# EasyEDA Pro project ProProject_IMUSensorNodes202312.epro, board 6_6_拼板20240123（不带编号） (continued)
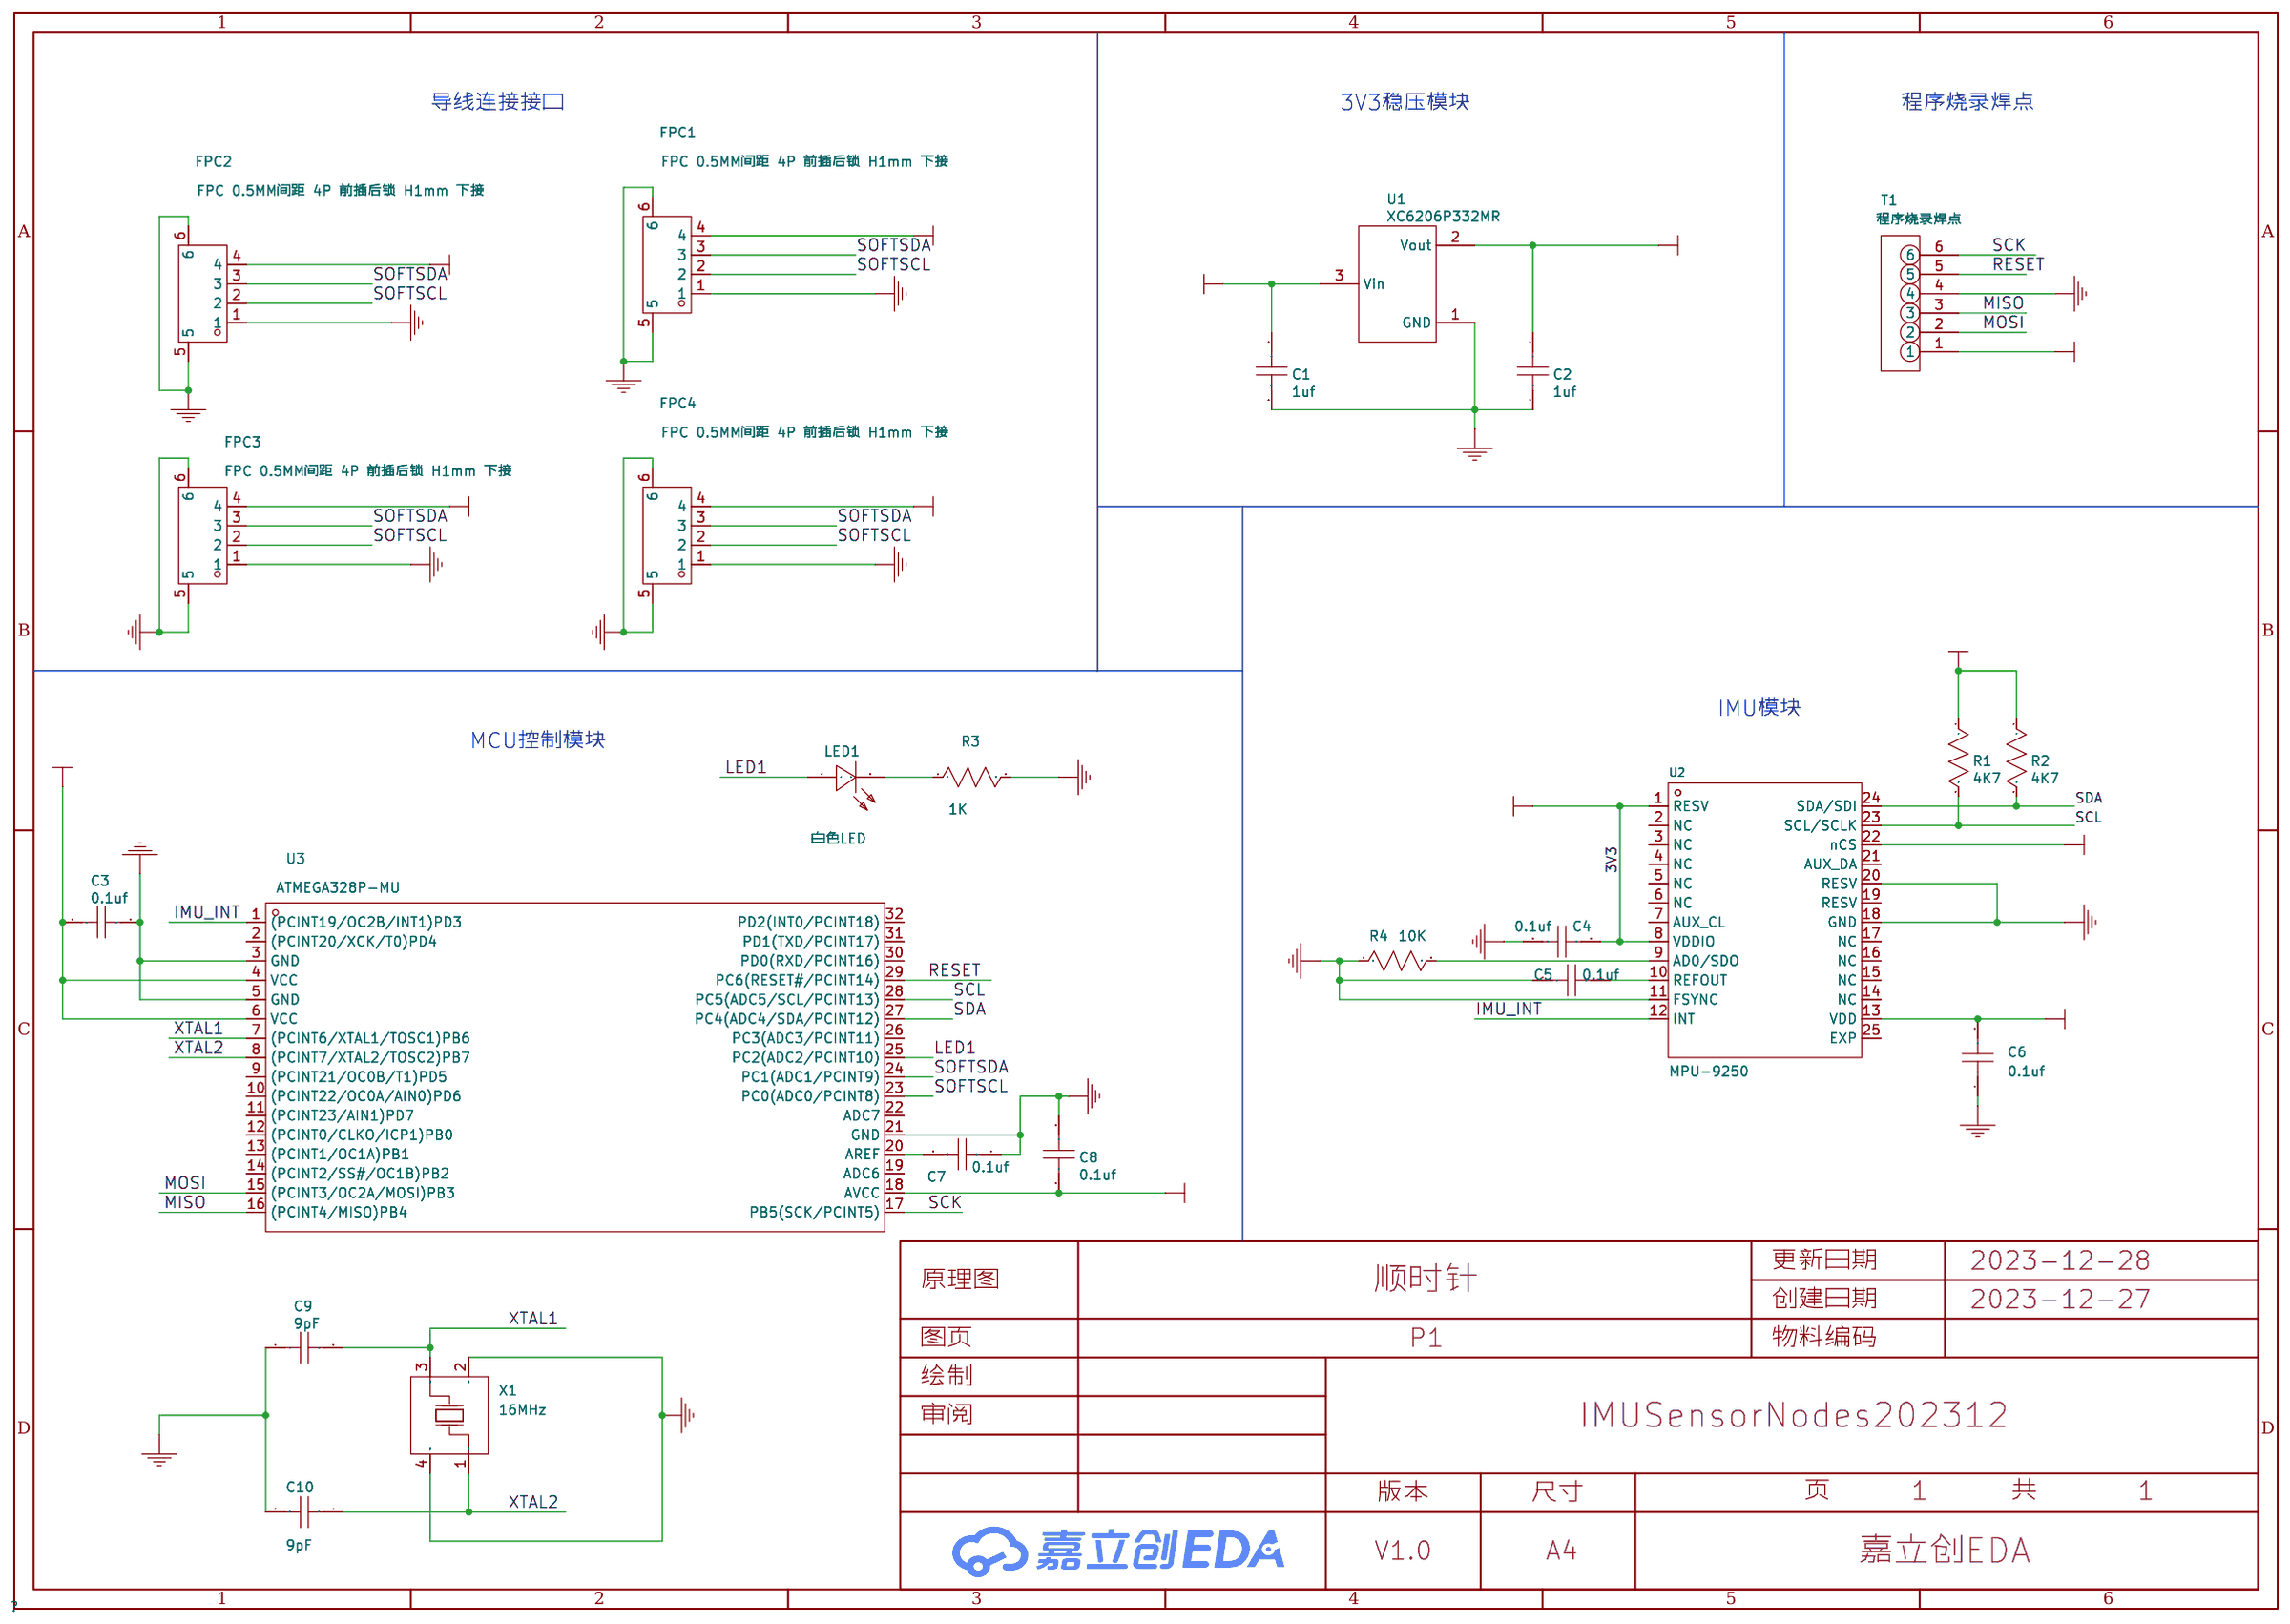
[diagram p0: schematic sheet]
## Routing (per net, layer and track width the routed paths; a pad name or vN(x,y) marks a point on that pad's centre or on a via; arc(x,y) is an arc through that point) (continued)
5V: length 82.8
  Bottom Layer w0.3: v1(22,34.32) 21.77,34.09 C1.1 22.13,33.68 ; 49.94,75.42 49.94,75.73 49.57,76.1 ; 49.57,62.39 49.94,62.01 49.94,61.7 ; U1#35.3 77.25,48.3 77.25,47.99 ; 49.43,47.4 C1#33.1 49.08,47.81 v1(49.31,48.03) ; 49.43,47.4 49.69,47.4 ; 49.43,47.4 arc(49.79,47.25) 49.94,46.89 49.94,46.02 arc(50.08,45.68) v1(50.42,45.54) ; 22.13,33.68 22.38,33.68 ; 22.13,33.68 arc(22.49,33.54) 22.64,33.18 22.64,32.31 arc(22.78,31.97) v1(23.12,31.83) ; 49.57,7.52 49.94,7.15 49.94,6.84 ; 49.57,21.24 49.94,20.86 49.94,20.55 ; v1(22,61.75) 21.77,61.52 C1#25.1 22.13,61.12 ; 22.13,61.12 22.38,61.12 ; 22.13,61.12 arc(22.49,60.97) 22.64,60.61 22.64,59.74 arc(22.78,59.4) v1(23.12,59.26) ; 49.43,33.68 C1#3.1 49.08,34.09 v1(49.31,34.32) ; 49.43,33.68 49.69,33.68 ; 49.43,33.68 arc(49.79,33.54) 49.94,33.18 49.94,32.31 arc(50.08,31.97) v1(50.42,31.83) ; 76.74,47.4 76.99,47.4 ; 76.74,47.4 C1#35.1 76.38,47.81 v1(76.61,48.03) ; 76.74,47.4 arc(77.1,47.25) 77.25,46.89 77.25,46.02 arc(77.39,45.68) v1(77.73,45.54) ; 77.25,6.84 77.25,7.15 U1#18.3 ; v1(76.61,75.47) 76.38,75.24 C1#6.1 76.74,74.83 ; v1(76.61,6.89) 76.38,6.66 C1#18.1 76.74,6.25 ; v1(22,20.6) 21.77,20.37 C1#8.1 22.13,19.97 ; v1(49.31,6.89) 49.08,6.66 C1#16.1 49.43,6.25 ; 22.64,34.27 22.64,34.58 U1.3 ; 22.13,74.83 22.38,74.83 ; 22.13,74.83 C1#21.1 21.77,75.24 v1(22,75.47) ; 22.13,74.83 arc(22.49,74.68) 22.64,74.32 22.64,73.46 arc(22.78,73.12) v1(23.12,72.98) ; 22.13,47.4 C1#31.1 21.77,47.81 v1(22,48.03) ; 22.13,47.4 22.38,47.4 ; 22.13,47.4 arc(22.49,47.25) 22.64,46.89 22.64,46.02 arc(22.78,45.68) v1(23.12,45.54) ; 22.13,6.25 C1#14.1 21.77,6.66 v1(22,6.89) ; 22.13,6.25 22.38,6.25 ; 22.13,6.25 arc(22.49,6.1) 22.64,5.74 22.64,4.88 arc(22.78,4.54) v1(23.12,4.4) ; 49.43,19.97 49.69,19.97 ; 49.43,19.97 C1#10.1 49.08,20.37 v1(49.31,20.6) ; 49.43,19.97 arc(49.79,19.82) 49.94,19.46 49.94,18.59 arc(50.08,18.25) v1(50.42,18.11) ; 22.64,61.7 22.64,62.01 U1#25.3 ; U1#31.3 22.64,48.3 22.64,47.99 ; 76.74,19.97 76.99,19.97 ; 76.74,19.97 C1#12.1 76.38,20.37 v1(76.61,20.6) ; 76.74,19.97 arc(77.1,19.82) 77.25,19.46 77.25,18.59 arc(77.39,18.25) v1(77.73,18.11) ; 76.74,6.25 76.99,6.25 ; 76.74,6.25 arc(77.1,6.1) 77.25,5.74 77.25,4.88 arc(77.39,4.54) v1(77.73,4.4) ; U1#12.3 77.25,20.86 77.25,20.55 ; U1#29.3 77.25,62.01 77.25,61.7 ; 77.25,34.27 77.25,34.58 U1#5.3 ; v1(49.31,75.47) 49.08,75.24 C1#23.1 49.43,74.83 ; 76.74,33.68 C1#5.1 76.38,34.09 v1(76.61,34.32) ; 76.74,33.68 76.99,33.68 ; 76.74,33.68 arc(77.1,33.54) 77.25,33.18 77.25,32.31 arc(77.39,31.97) v1(77.73,31.83) ; 49.43,74.83 49.69,74.83 ; 49.43,74.83 arc(49.79,74.68) 49.94,74.32 49.94,73.46 arc(50.08,73.12) v1(50.42,72.98) ; v1(49.31,61.75) 49.08,61.52 C1#27.1 49.43,61.12 ; 49.57,34.95 49.94,34.58 49.94,34.27 ; 49.43,61.12 49.69,61.12 ; 49.43,61.12 arc(49.79,60.97) 49.94,60.61 49.94,59.74 arc(50.08,59.4) v1(50.42,59.26) ; 49.57,48.67 49.94,48.3 49.94,47.99 ; 22.64,75.42 22.64,75.73 U1#21.3 ; 76.74,61.12 76.99,61.12 ; 76.74,61.12 C1#29.1 76.38,61.52 v1(76.61,61.75) ; 76.74,61.12 arc(77.1,60.97) 77.25,60.61 77.25,59.74 arc(77.39,59.4) v1(77.73,59.26) ; U1#8.3 22.64,20.86 22.64,20.55 ; U1#6.3 77.25,75.73 77.25,75.42 ; 22.64,6.84 22.64,7.15 U1#14.3 ; 49.43,6.25 49.69,6.25 ; 49.43,6.25 arc(49.79,6.1) 49.94,5.74 49.94,4.88 arc(50.08,4.54) v1(50.42,4.4) ; 22.13,19.97 22.38,19.97 ; 22.13,19.97 arc(22.49,19.82) 22.64,19.46 22.64,18.59 arc(22.78,18.25) v1(23.12,18.11) ; 76.74,74.83 76.99,74.83 ; 76.74,74.83 arc(77.1,74.68) 77.25,74.32 77.25,73.46 arc(77.39,73.12) v1(77.73,72.98)
  vias: v1(7.64,73.81) v1(7.64,60.1) v1(7.64,46.38) v1(7.64,32.67) v1(7.64,18.95) v1(7.64,5.23) v1(34.95,73.81) v1(34.95,60.1) v1(34.95,46.38) v1(34.95,32.67) v1(34.95,18.95) v1(34.95,5.23) v1(62.25,73.81) v1(62.25,60.1) v1(62.25,46.38) v1(62.25,32.67) v1(62.25,18.95) v1(62.25,5.23)
GND: length 1731.1
  Top Layer w0.127: X1#17.4 50.18,9.79 50.98,10.59 X1#17.2 ; X1#34.2 50.98,51.74 50.18,50.94 X1#34.4 ; v1(29.11,63.53) 29.94,63.53 30.38,63.97 30.38,65.69 30.76,66.07 31.39,66.07 FPC2#35.6 ; X1#13.2 50.98,24.3 50.18,23.5 X1#13.4 ; X1#8.4 77.48,37.22 78.28,38.02 X1#8.2 ; v1(62.06,71.91) 62.58,72.42 65.35,72.42 FPC3#25.5 ; FPC2#36.6 31.39,11.21 30.76,11.21 30.38,10.82 30.38,9.11 29.94,8.66 v1(29.11,8.66) ; 9.16,78.22 9.16,78.37 9.56,78.77 9.71,78.77 v2(9.96,79.02) ; 63.77,78.22 63.77,78.37 64.17,78.77 64.32,78.77 v2(64.57,79.02) ; X1#15.2 23.67,10.59 22.87,9.79 X1#15.4 ; v2(37.27,24.16) 37.01,23.91 36.86,23.91 36.46,23.5 X1#12.4 ; X1.4 63.77,23.5 64.17,23.91 64.32,23.91 v2(64.57,24.16) ; FPC2#32.6 58.69,11.21 58.07,11.21 57.69,10.82 57.69,9.11 57.25,8.66 v1(56.42,8.66) ; X1#18.4 63.77,9.79 64.17,10.19 64.32,10.19 v2(64.57,10.44) ; X1#28.2 50.98,65.45 50.18,64.65 X1#28.4 ; FPC3#10.5 10.74,44.99 7.97,44.99 v1(7.45,44.47) ; FPC2#25.6 58.69,52.35 58.07,52.35 57.69,51.97 57.69,50.26 57.25,49.81 v1(56.42,49.81) ; 77.48,78.22 77.48,78.37 78.28,79.17 X1#9.2 ; v1(56.42,63.53) 57.25,63.53 57.69,63.97 57.69,65.69 58.07,66.07 58.69,66.07 FPC2#12.6 ; v1(1.81,36.1) 2.64,36.1 3.08,36.54 3.08,38.26 3.46,38.64 4.08,38.64 FPC2#13.6 ; X1#11.4 22.87,23.5 23.67,24.3 X1#11.2 ; v1(1.81,49.81) 2.64,49.81 3.08,50.26 3.08,51.97 3.46,52.35 4.08,52.35 FPC2#10.6 ; FPC3#5.5 65.35,3.84 62.58,3.84 v1(62.06,3.32) ; v2(64.57,51.59) 64.32,51.34 64.17,51.34 63.77,50.94 X1#35.4 ; v1(34.76,44.47) 35.27,44.99 38.04,44.99 FPC3#26.5 ; X1#29.4 63.77,64.65 64.17,65.05 64.32,65.05 v2(64.57,65.31) ; FPC2#7.6 58.69,38.64 58.07,38.64 57.69,38.26 57.69,36.54 57.25,36.1 v1(56.42,36.1) ; X1#26.4 22.87,64.65 23.67,65.45 X1#26.2 ; FPC3#31.5 65.35,31.27 62.58,31.27 v1(62.06,30.76) ; FPC3#32.5 65.35,44.99 62.58,44.99 v1(62.06,44.47) ; FPC3#17.5 38.04,58.7 35.27,58.7 v1(34.76,58.19) ; 36.46,78.22 36.46,78.37 36.86,78.77 37.01,78.77 v2(37.27,79.02) ; X1#33.4 36.46,50.94 36.86,51.34 37.01,51.34 v2(37.27,51.59) ; v1(7.45,17.04) 7.97,17.56 10.74,17.56 FPC3#12.5 ; X1#30.2 78.28,65.45 77.48,64.65 X1#30.4 ; X1#16.4 36.46,9.79 36.86,10.19 37.01,10.19 v2(37.27,10.44) ; v1(7.45,71.91) 7.97,72.42 10.74,72.42 FPC3#36.5 ; X1#25.4 9.16,64.65 9.56,65.05 9.71,65.05 v2(9.96,65.31) ; v2(37.27,65.31) 37.01,65.05 36.86,65.05 36.46,64.65 X1#27.4 ; X1#6.2 50.98,38.02 50.18,37.22 X1#6.4 ; FPC3#8.5 10.74,58.7 7.97,58.7 v1(7.45,58.19) ; v2(9.96,37.88) 9.71,37.62 9.56,37.62 9.16,37.22 X1#3.4 ; v1(1.81,77.25) 2.64,77.25 3.08,77.69 3.08,79.4 3.46,79.78 4.08,79.78 FPC2#8.6 ; FPC3#27.5 10.74,31.27 7.97,31.27 v1(7.45,30.76) ; FPC2#21.6 31.39,38.64 30.76,38.64 30.38,38.26 30.38,36.54 29.94,36.1 v1(29.11,36.1) ; v1(1.81,63.53) 2.64,63.53 3.08,63.97 3.08,65.69 3.46,66.07 4.08,66.07 FPC2#19.6 ; v2(9.96,24.16) 9.71,23.91 9.56,23.91 9.16,23.5 X1#10.4 ; FPC2#11.6 58.69,79.78 58.07,79.78 57.69,79.4 57.69,77.69 57.25,77.25 v1(56.42,77.25) ; v1(29.11,22.38) 29.94,22.38 30.38,22.82 30.38,24.54 30.76,24.92 31.39,24.92 FPC2#33.6 ; X1#19.4 77.48,9.79 78.28,10.59 X1#19.2 ; FPC3#20.5 38.04,72.42 35.27,72.42 v1(34.76,71.91) ; v2(9.96,51.59) 9.71,51.34 9.56,51.34 9.16,50.94 X1#31.4 ; 50.18,78.22 50.18,78.37 50.98,79.17 X1#24.2 ; v1(62.06,58.19) 62.58,58.7 65.35,58.7 FPC3#30.5 ; FPC3#14.5 38.04,3.84 35.27,3.84 v1(34.76,3.32) ; X1#36.2 78.28,51.74 77.48,50.94 X1#36.4 ; v1(34.76,30.76) 35.27,31.27 38.04,31.27 FPC3.5 ; FPC3#15.5 10.74,3.84 7.97,3.84 v1(7.45,3.32) ; FPC3#13.5 65.35,17.56 62.58,17.56 v1(62.06,17.04) ; v2(64.57,37.88) 64.32,37.62 64.17,37.62 63.77,37.22 X1#7.4 ; FPC2#23.6 31.39,79.78 30.76,79.78 30.38,79.4 30.38,77.69 29.94,77.25 v1(29.11,77.25) ; FPC2#4.6 4.08,11.21 3.46,11.21 3.08,10.82 3.08,9.11 2.64,8.66 v1(1.81,8.66) ; X1#22.2 23.67,79.17 22.87,78.37 22.87,78.22 ; X1#2.4 77.48,23.5 78.28,24.3 X1#2.2 ; v1(1.81,22.38) 2.64,22.38 3.08,22.82 3.08,24.54 3.46,24.92 4.08,24.92 FPC2#6.6 ; FPC2#9.6 31.39,52.35 30.76,52.35 30.38,51.97 30.38,50.26 29.94,49.81 v1(29.11,49.81) ; v2(37.27,37.88) 37.01,37.62 36.86,37.62 36.46,37.22 X1#5.4 ; X1#4.4 22.87,37.22 23.67,38.02 X1#4.2 ; X1#32.4 22.87,50.94 23.67,51.74 X1#32.2 ; v2(9.96,10.44) 9.71,10.19 9.56,10.19 9.16,9.79 X1#14.4 ; FPC2#34.6 58.69,24.92 58.07,24.92 57.69,24.54 57.69,22.82 57.25,22.38 v1(56.42,22.38) ; v1(34.76,17.04) 35.27,17.56 38.04,17.56 FPC3#6.5
  Top Layer w0.2: FPC1#21.4 29.89,18.96 29.24,18.32 ; 29.24,4.6 29.89,5.25 FPC1#2.4 ; 69.65,32.3 70.88,32.3 v1(71.28,31.91) ; 76.36,49.43 78.92,49.43 FPC3#33.6 ; FPC3#28.6 24.31,49.43 21.75,49.43 ; 42.34,32.3 43.58,32.3 v1(43.97,31.91) ; v1(16.67,73.05) 16.27,73.45 15.03,73.45 ; v1(43.97,45.62) 43.58,46.02 42.34,46.02 ; 76.36,63.15 78.92,63.15 FPC3#11.6 ; 1.94,32.04 2.58,32.68 FPC1#12.4 ; FPC1#13.4 2.58,5.25 1.94,4.6 ; v1(16.67,18.19) 16.27,18.58 15.03,18.58 ; 69.65,4.87 70.88,4.87 v1(71.28,4.47) ; FPC3#3.6 78.92,22 76.36,22 ; 56.55,4.6 57.19,5.25 FPC1#28.4 ; 76.36,35.72 78.92,35.72 FPC3#23.6 ; v1(71.28,45.62) 70.88,46.02 69.65,46.02 ; 49.05,8.28 51.62,8.28 FPC3#34.6 ; FPC1#34.4 57.19,18.96 56.55,18.32 ; FPC1#17.4 57.19,46.4 56.55,45.75 ; v1(71.28,59.34) 70.88,59.73 69.65,59.73 ; FPC1#36.4 29.89,32.68 29.24,32.04 ; 21.75,8.28 24.31,8.28 FPC3#29.6 ; 15.03,59.73 16.27,59.73 v1(16.67,59.34) ; 49.05,22 51.62,22 FPC3#18.6 ; 49.05,63.15 51.62,63.15 FPC3#24.6 ; 76.36,8.28 78.92,8.28 FPC3#35.6 ; FPC1#18.4 29.89,46.4 29.24,45.75 ; FPC1#32.4 2.58,46.4 1.94,45.75 ; v1(43.97,18.19) 43.58,18.58 42.34,18.58 ; 69.65,73.45 70.88,73.45 v1(71.28,73.05) ; 29.24,59.47 29.89,60.11 FPC1#14.4 ; 49.05,35.72 51.62,35.72 FPC3#9.6 ; v1(43.97,73.05) 43.58,73.45 42.34,73.45 ; FPC1#8.4 57.19,73.83 56.55,73.18 ; v1(71.28,18.19) 70.88,18.58 69.65,18.58 ; 56.55,32.04 57.19,32.68 FPC1#24.4 ; 21.75,35.72 24.31,35.72 FPC3#7.6 ; v1(43.97,59.34) 43.58,59.73 42.34,59.73 ; v1(16.67,31.91) 16.27,32.3 15.03,32.3 ; FPC3#4.6 78.92,76.86 76.36,76.86 ; 21.75,76.86 24.31,76.86 FPC3#16.6 ; 1.94,73.18 2.58,73.83 FPC1#4.4 ; 42.34,4.87 43.58,4.87 v1(43.97,4.47) ; 21.75,63.15 24.31,63.15 FPC3#19.6 ; 21.75,22 24.31,22 FPC3#2.6 ; FPC1#31.4 29.89,73.83 29.24,73.18 ; FPC1#6.4 57.19,60.11 56.55,59.47 ; 49.05,76.86 51.62,76.86 FPC3#21.6 ; 15.03,46.02 16.27,46.02 v1(16.67,45.62) ; 15.03,4.87 16.27,4.87 v1(16.67,4.47) ; FPC1#5.4 2.58,18.96 1.94,18.32 ; FPC3#22.6 51.62,49.43 49.05,49.43 ; 1.94,59.47 2.58,60.11 FPC1.4
  Top Layer w0.22: FPC1#12.6 1.54,31.64 1.94,32.04 ; 56.55,45.75 56.15,45.35 FPC1#17.6 ; FPC1#18.6 28.84,45.35 29.24,45.75 ; FPC1#36.6 28.84,31.64 29.24,32.04 ; 1.94,73.18 1.54,72.78 FPC1#4.6 ; 29.24,4.6 28.84,4.2 FPC1#2.6 ; 56.55,59.47 56.15,59.07 FPC1#6.6 ; 1.94,18.32 1.54,17.92 FPC1#5.6 ; 29.24,73.18 28.84,72.78 FPC1#31.6 ; 1.94,4.6 1.54,4.2 FPC1#13.6 ; 56.55,32.04 56.15,31.64 FPC1#24.6 ; FPC1#8.6 56.15,72.78 56.55,73.18 ; 56.55,18.32 56.15,17.92 FPC1#34.6 ; FPC1.6 1.54,59.07 1.94,59.47 ; 1.94,45.75 1.54,45.35 FPC1#32.6 ; FPC1#28.6 56.15,4.2 56.55,4.6 ; FPC1#14.6 28.84,59.07 29.24,59.47 ; FPC1#21.6 28.84,17.92 29.24,18.32
  Top Layer w0.254: 69.24,4.46 FPC1#7.5 69.43,8 v1(69.9,8) ; 69.24,4.46 70.66,5.89 70.66,6.4 71.01,6.75 FPC1#7.1 ; 69.24,4.46 FPC1#7.6 ; 37.84,38.17 X1#5.2 37.24,38.19 37.24,38.76 ; 37.84,38.17 37.24,38.76 ; 37.84,38.17 38.02,38.17 v1(38.51,37.68) ; 37.24,25.05 37.84,24.45 ; 37.24,25.05 37.12,25.17 35.49,25.17 FPC2#33.5 ; 37.24,25.05 37.24,24.47 X1#12.2 37.84,24.45 ; 37.84,24.45 38.02,24.45 v1(38.51,23.96) ; v1(69.9,49.15) 69.43,49.15 FPC1#29.5 69.24,45.61 ; v1(44.9,51.34) 45.23,51.67 FPC2#24.6 45.6,52.61 48.46,52.61 FPC2#24.5 48.83,50.87 48.92,50.79 ; FPC2#35.5 35.49,66.32 37.12,66.32 37.24,66.2 ; 37.84,51.89 X1#33.2 37.24,51.91 37.24,52.48 ; 37.84,51.89 38.02,51.89 v1(38.51,51.4) ; 37.84,51.89 37.24,52.48 ; FPC1#29.6 69.24,45.61 ; 69.24,45.61 70.66,47.03 70.66,47.55 71.01,47.9 FPC1#29.1 ; FPC1#35.6 14.63,73.04 ; 14.63,73.04 FPC1#35.5 14.82,76.58 v1(15.29,76.58) ; 14.63,73.04 16.05,74.47 16.05,74.98 16.4,75.33 FPC1#35.1 ; FPC1#30.1 71.01,61.61 70.66,61.26 70.66,60.75 69.24,59.33 ; 41.94,18.18 43.36,19.6 43.36,20.12 43.71,20.46 FPC1#9.1 ; 41.94,18.18 FPC1#9.5 42.12,21.71 v1(42.6,21.71) ; 41.94,18.18 FPC1#9.6 ; FPC1#19.6 14.63,18.18 ; 14.63,18.18 16.05,19.6 16.05,20.12 16.4,20.46 FPC1#19.1 ; 14.63,18.18 FPC1#19.5 14.82,21.71 v1(15.29,21.71) ; X1#6.4 48.92,37.07 ; 48.92,37.07 48.92,36.94 v1(48.04,36.06) 48.38,35.72 49.05,35.72 ; 48.92,37.07 48.83,37.16 FPC2#27.5 48.46,38.89 45.6,38.89 FPC2#27.6 45.23,37.96 v1(44.9,37.63) ; 64.55,38.76 64.42,38.89 62.79,38.89 FPC2#7.5 ; 64.55,38.76 64.55,38.19 X1#7.2 65.14,38.17 ; 64.55,38.76 65.14,38.17 ; v1(1.81,22.38) 1.77,22.38 FPC1#5.5 ; 21.61,23.36 21.53,23.44 FPC2#5.5 21.15,25.17 18.3,25.17 FPC2#5.6 17.92,24.24 v1(17.59,23.91) ; 21.61,23.36 21.61,23.23 v1(20.73,22.35) 21.08,22 21.75,22 ; 21.61,23.36 X1#11.4 ; 64.55,25.05 64.42,25.17 62.79,25.17 FPC2#34.5 ; 64.55,25.05 64.55,24.47 X1.2 65.14,24.45 ; 64.55,25.05 65.14,24.45 ; 64.55,11.33 64.42,11.46 62.79,11.46 FPC2#32.5 ; 64.55,11.33 64.55,10.76 X1#18.2 65.14,10.74 ; 64.55,11.33 65.14,10.74 ; 49.05,49.43 48.38,49.43 v1(48.04,49.78) 48.92,50.66 48.92,50.79 ; 14.63,45.61 FPC1#27.5 14.82,49.15 v1(15.29,49.15) ; 14.63,45.61 FPC1#27.6 ; 14.63,45.61 16.05,47.03 16.05,47.55 16.4,47.9 FPC1#27.1 ; v1(11.21,23.96) 10.72,24.45 10.53,24.45 ; 69.24,73.04 FPC1#15.5 69.43,76.58 v1(69.9,76.58) ; 69.24,73.04 FPC1#15.6 ; 69.24,73.04 70.66,74.47 70.66,74.98 71.01,75.33 FPC1#15.1 ; R3#3.2 41.81,29.02 arc(41.94,28.73) v1(42.23,28.6) ; 65.14,51.89 65.33,51.89 v1(65.82,51.4) ; 65.14,51.89 64.55,52.48 ; 65.14,51.89 X1#35.2 64.55,51.91 64.55,52.48 ; 37.84,79.32 38.02,79.32 v1(38.51,78.83) ; 37.84,79.32 X1#23.2 37.24,79.34 37.24,79.91 ; 37.84,79.32 37.24,79.91 ; v1(17.59,78.78) 17.92,79.1 FPC2#30.6 18.3,80.04 21.15,80.04 FPC2#30.5 21.53,78.31 21.61,78.22 ; X1#30.4 76.22,64.5 ; 76.22,64.5 76.22,64.38 v1(75.34,63.5) 75.69,63.15 76.36,63.15 ; 76.22,64.5 76.14,64.59 FPC2#31.5 75.76,66.32 72.91,66.32 FPC2#31.6 72.53,65.39 v1(72.2,65.06) ; 9.94,38.76 9.94,38.19 X1#3.2 10.53,38.17 ; 9.94,38.76 10.53,38.17 ; 9.94,38.76 9.81,38.89 8.19,38.89 FPC2#13.5 ; 76.22,23.36 76.22,23.23 v1(75.34,22.35) 75.69,22 76.36,22 ; 76.22,23.36 X1#2.4 ; 76.22,23.36 76.14,23.44 FPC2#20.5 75.76,25.17 72.91,25.17 FPC2#20.6 72.53,24.24 v1(72.2,23.91) ; v1(65.82,10.25) 65.33,10.74 65.14,10.74 ; 76.36,35.72 75.69,35.72 v1(75.34,36.06) 76.22,36.94 76.22,37.07 ; 10.53,10.74 X1#14.2 9.94,10.76 9.94,11.33 ; 10.53,10.74 9.94,11.33 ; 10.53,10.74 10.72,10.74 v1(11.21,10.25) ; R3#23.2 41.81,70.17 arc(41.94,69.87) v1(42.23,69.75) ; FPC1#16.6 41.94,45.61 ; 41.94,45.61 43.36,47.03 43.36,47.55 43.71,47.9 FPC1#16.1 ; 41.94,45.61 FPC1#16.5 42.12,49.15 v1(42.6,49.15) ; 48.92,23.36 48.92,23.23 v1(48.04,22.35) 48.38,22 49.05,22 ; 48.92,23.36 X1#13.4 ; 48.92,23.36 48.83,23.44 FPC2#16.5 48.46,25.17 45.6,25.17 FPC2#16.6 45.23,24.24 v1(44.9,23.91) ; 76.22,37.07 76.14,37.16 FPC2#18.5 75.76,38.89 72.91,38.89 FPC2#18.6 72.53,37.96 v1(72.2,37.63) ; 76.22,37.07 X1#8.4 ; v1(11.21,37.68) 10.72,38.17 10.53,38.17 ; R3#35.2 69.12,42.74 arc(69.24,42.44) v1(69.54,42.32) ; 65.14,65.6 65.33,65.6 v1(65.82,65.11) ; 65.14,65.6 64.55,66.2 ; 65.14,65.6 X1#29.2 64.55,65.62 64.55,66.2 ; FPC2#19.5 8.19,66.32 9.81,66.32 9.94,66.2 ; 49.05,63.15 48.38,63.15 v1(48.04,63.5) 48.92,64.38 48.92,64.5 ; 37.24,79.91 37.12,80.04 35.49,80.04 FPC2#23.5 ; v1(29.11,36.1) 29.08,36.1 FPC1#36.5 ; v1(1.81,36.1) 1.77,36.1 FPC1#12.5 ; 64.55,66.2 64.42,66.32 62.79,66.32 FPC2#12.5 ; FPC1.5 1.77,63.53 v1(1.81,63.53) ; 14.63,59.33 16.05,60.75 16.05,61.26 16.4,61.61 FPC1#23.1 ; 14.63,59.33 FPC1#23.5 14.82,62.86 v1(15.29,62.86) ; 14.63,59.33 FPC1#23.6 ; 48.92,64.5 48.83,64.59 FPC2#26.5 48.46,66.32 45.6,66.32 FPC2#26.6 45.23,65.39 v1(44.9,65.06) ; 48.92,64.5 X1#28.4 ; 65.14,24.45 65.33,24.45 v1(65.82,23.96) ; v1(72.2,51.34) 72.53,51.67 FPC2.6 72.91,52.61 75.76,52.61 FPC2.5 76.14,50.87 76.22,50.79 ; 37.24,52.48 37.12,52.61 35.49,52.61 FPC2#9.5 ; 64.55,52.48 64.42,52.61 62.79,52.61 FPC2#25.5 ; 9.94,52.48 9.81,52.61 8.19,52.61 FPC2#10.5 ; 9.94,52.48 9.94,51.91 X1#31.2 10.53,51.89 ; 9.94,52.48 10.53,51.89 ; 9.94,11.33 9.81,11.46 8.19,11.46 FPC2#4.5 ; 48.92,9.64 48.92,9.51 v1(48.04,8.63) 48.38,8.28 49.05,8.28 ; 48.92,9.64 X1#17.4 ; 48.92,9.64 48.83,9.73 FPC2#22.5 48.46,11.46 45.6,11.46 FPC2#22.6 45.23,10.52 v1(44.9,10.19) ; R3#14.2 14.51,1.59 arc(14.63,1.29) v1(14.93,1.17) ; FPC1#32.5 1.77,49.81 v1(1.81,49.81) ; v1(44.9,78.78) 45.23,79.1 FPC2#2.6 45.6,80.04 48.46,80.04 FPC2#2.5 48.83,78.31 48.92,78.22 ; FPC1#28.5 56.38,8.66 v1(56.42,8.66) ; v1(17.59,51.34) 17.92,51.67 FPC2#29.6 18.3,52.61 21.15,52.61 FPC2#29.5 21.53,50.87 21.61,50.79 ; 48.92,50.79 X1#34.4 ; v1(1.81,8.66) 1.77,8.66 FPC1#13.5 ; FPC1#17.5 56.38,49.81 v1(56.42,49.81) ; v1(15.29,35.43) 14.82,35.43 FPC1#33.5 14.63,31.89 ; 21.75,49.43 21.08,49.43 v1(20.73,49.78) 21.61,50.66 21.61,50.79 ; FPC1#25.6 69.24,18.18 ; 69.24,18.18 FPC1#25.5 69.43,21.71 v1(69.9,21.71) ; 69.24,18.18 70.66,19.6 70.66,20.12 71.01,20.46 FPC1#25.1 ; 37.24,66.2 37.84,65.6 ; 37.24,66.2 37.24,65.62 X1#27.2 37.84,65.6 ; 37.84,65.6 38.02,65.6 v1(38.51,65.11) ; R3#6.2 69.12,70.17 arc(69.24,69.87) v1(69.54,69.75) ; 10.53,79.32 X1#20.2 9.94,79.34 9.94,79.91 ; 10.53,79.32 10.72,79.32 v1(11.21,78.83) ; 10.53,79.32 9.94,79.91 ; FPC1#10.1 16.4,6.75 16.05,6.4 16.05,5.89 14.63,4.46 ; 37.24,38.76 37.12,38.89 35.49,38.89 FPC2#21.5 ; 21.61,37.07 21.53,37.16 FPC2#17.5 21.15,38.89 18.3,38.89 FPC2#17.6 17.92,37.96 v1(17.59,37.63) ; 21.61,37.07 21.61,36.94 v1(20.73,36.06) 21.08,35.72 21.75,35.72 ; 21.61,37.07 X1#4.4 ; v1(1.81,77.25) 1.77,77.25 FPC1#4.5 ; v1(56.42,77.25) 56.38,77.25 FPC1#8.5 ; FPC2#8.5 8.19,80.04 9.81,80.04 9.94,79.91 ; 41.94,4.46 FPC1#22.5 42.12,8 v1(42.6,8) ; 41.94,4.46 FPC1#22.6 ; 41.94,4.46 43.36,5.89 43.36,6.4 43.71,6.75 FPC1#22.1 ; R3#27.2 41.81,56.45 arc(41.94,56.16) v1(42.23,56.04) ; X1#15.4 21.61,9.64 ; 21.61,9.64 21.53,9.73 FPC2#14.5 21.15,11.46 18.3,11.46 FPC2#14.6 17.92,10.52 v1(17.59,10.19) ; 21.61,9.64 21.61,9.51 v1(20.73,8.63) 21.08,8.28 21.75,8.28 ; v1(29.11,8.66) 29.08,8.66 FPC1#2.5 ; 76.36,76.86 75.69,76.86 v1(75.34,77.21) 76.22,78.09 76.22,78.22 ; 48.92,78.22 48.92,78.09 v1(48.04,77.21) 48.38,76.86 49.05,76.86 ; 48.92,78.22 50.18,78.22 ; v1(72.2,10.19) 72.53,10.52 FPC2#15.6 72.91,11.46 75.76,11.46 FPC2#15.5 76.14,9.73 76.22,9.64 ; 37.24,11.33 37.84,10.74 ; 37.24,11.33 37.12,11.46 35.49,11.46 FPC2#36.5 ; 37.24,11.33 37.24,10.76 X1#16.2 37.84,10.74 ; 37.84,10.74 38.02,10.74 v1(38.51,10.25) ; 21.61,50.79 X1#32.4 ; 76.36,49.43 75.69,49.43 v1(75.34,49.78) 76.22,50.66 76.22,50.79 ; v1(56.42,36.1) 56.38,36.1 FPC1#24.5 ; FPC1#26.6 41.94,31.89 ; 41.94,31.89 43.36,33.32 43.36,33.83 43.71,34.18 FPC1#26.1 ; 41.94,31.89 FPC1#26.5 42.12,35.43 v1(42.6,35.43) ; 9.94,66.2 9.94,65.62 X1#25.2 10.53,65.6 ; 9.94,66.2 10.53,65.6 ; FPC1#33.6 14.63,31.89 ; 14.63,31.89 16.05,33.32 16.05,33.83 16.4,34.18 FPC1#33.1 ; FPC1#3.6 69.24,31.89 ; 69.24,31.89 FPC1#3.5 69.43,35.43 v1(69.9,35.43) ; 69.24,31.89 70.66,33.32 70.66,33.83 71.01,34.18 FPC1#3.1 ; FPC1#21.5 29.08,22.38 v1(29.11,22.38) ; 65.14,79.32 65.33,79.32 v1(65.82,78.83) ; 65.14,79.32 X1#21.2 64.55,79.34 64.55,79.91 ; 65.14,79.32 64.55,79.91 ; 69.24,59.33 FPC1#30.6 ; 69.24,59.33 FPC1#30.5 69.43,62.86 v1(69.9,62.86) ; v1(11.21,51.4) 10.72,51.89 10.53,51.89 ; v1(29.11,49.81) 29.08,49.81 FPC1#18.5 ; FPC1#14.5 29.08,63.53 v1(29.11,63.53) ; v1(42.6,76.58) 42.12,76.58 FPC1#20.5 41.94,73.04 ; v1(15.29,8) 14.82,8 FPC1#10.5 14.63,4.46 ; v1(11.21,65.11) 10.72,65.6 10.53,65.6 ; 76.22,50.79 X1#36.4 ; v1(72.2,78.78) 72.53,79.1 FPC2#3.6 72.91,80.04 75.76,80.04 FPC2#3.5 76.14,78.31 76.22,78.22 ; 76.22,9.64 76.22,9.51 v1(75.34,8.63) 75.69,8.28 76.36,8.28 ; 76.22,9.64 X1#19.4 ; v1(42.6,62.86) 42.12,62.86 FPC1#11.5 41.94,59.33 ; FPC1#31.5 29.08,77.25 v1(29.11,77.25) ; R3#33.2 41.81,42.74 arc(41.94,42.44) v1(42.23,42.32) ; 22.87,78.22 21.61,78.22 ; 21.61,78.22 21.61,78.09 v1(20.73,77.21) 21.08,76.86 21.75,76.86 ; FPC2#11.5 62.79,80.04 64.42,80.04 64.55,79.91 ; v1(56.42,63.53) 56.38,63.53 FPC1#6.5 ; FPC1#11.1 43.71,61.61 43.36,61.26 43.36,60.75 41.94,59.33 ; 9.94,25.05 9.81,25.17 8.19,25.17 FPC2#6.5 ; 9.94,25.05 10.53,24.45 ; 9.94,25.05 9.94,24.47 X1#10.2 10.53,24.45 ; R3#10.2 41.81,15.31 arc(41.94,15.01) v1(42.23,14.89) ; 76.22,78.22 77.48,78.22 ; R3#21.2 14.51,70.17 arc(14.63,69.87) v1(14.93,69.75) ; R3#31.2 14.51,42.74 arc(14.63,42.44) v1(14.93,42.32) ; X1#26.4 21.61,64.5 ; 21.61,64.5 21.53,64.59 FPC2#28.5 21.15,66.32 18.3,66.32 FPC2#28.6 17.92,65.39 v1(17.59,65.06) ; 21.61,64.5 21.61,64.38 v1(20.73,63.5) 21.08,63.15 21.75,63.15 ; FPC1#20.6 41.94,73.04 ; 41.94,73.04 43.36,74.47 43.36,74.98 43.71,75.33 FPC1#20.1 ; R3#25.2 14.51,56.45 arc(14.63,56.16) v1(14.93,56.04) ; 41.94,59.33 FPC1#11.6 ; FPC1#10.6 14.63,4.46 ; R3#18.2 69.12,1.59 arc(69.24,1.29) v1(69.54,1.17) ; R3#16.2 41.81,1.59 arc(41.94,1.29) v1(42.23,1.17) ; R3#8.2 14.51,15.31 arc(14.63,15.01) v1(14.93,14.89) ; R3.2 14.51,29.02 arc(14.63,28.73) v1(14.93,28.6) ; R3#29.2 69.12,56.45 arc(69.24,56.16) v1(69.54,56.04) ; 65.14,38.17 65.33,38.17 v1(65.82,37.68) ; v1(56.42,22.38) 56.38,22.38 FPC1#34.5 ; R3#5.2 69.12,29.02 arc(69.24,28.73) v1(69.54,28.6) ; R3#12.2 69.12,15.31 arc(69.24,15.01) v1(69.54,14.89)
  Top Layer w0.4: FPC3#33.5 FPC3#33.6 79.41,51.47 v1(79.53,51.59) ; FPC3#3.5 FPC3#3.6 79.41,24.04 v1(79.53,24.16) ; FPC1#21.5 FPC1#21.6 ; FPC1#28.5 FPC1#28.6 ; v1(24.92,79.02) 24.8,78.9 FPC3#16.6 FPC3#16.5 ; FPC3#34.5 FPC3#34.6 52.11,10.32 v1(52.23,10.44) ; FPC3#29.5 FPC3#29.6 24.8,10.32 v1(24.92,10.44) ; FPC3#4.5 FPC3#4.6 79.41,78.9 v1(79.53,79.02) ; FPC3#28.5 FPC3#28.6 24.8,51.47 v1(24.92,51.59) ; v1(24.92,24.16) 24.8,24.04 FPC3#2.6 FPC3#2.5 ; FPC3#19.5 FPC3#19.6 24.8,65.19 v1(24.92,65.31) ; v1(24.92,37.88) 24.8,37.75 FPC3#7.6 FPC3#7.5 ; FPC3#23.5 FPC3#23.6 79.41,37.75 v1(79.53,37.88) ; v1(52.23,51.59) 52.11,51.47 FPC3#22.6 FPC3#22.5 ; FPC1#13.5 FPC1#13.6 ; FPC3#24.5 FPC3#24.6 52.11,65.19 v1(52.23,65.31) ; FPC1#14.5 FPC1#14.6 ; v1(79.53,65.31) 79.41,65.19 FPC3#11.6 FPC3#11.5 ; FPC1#2.5 FPC1#2.6 ; FPC3#21.5 FPC3#21.6 52.11,78.9 v1(52.23,79.02) ; FPC1#34.5 FPC1#34.6 ; FPC1#6.5 FPC1#6.6 ; FPC3#9.5 FPC3#9.6 52.11,37.75 v1(52.23,37.88) ; FPC1.5 FPC1.6 ; FPC1#32.5 FPC1#32.6 ; FPC1#24.5 FPC1#24.6 ; FPC1#12.5 FPC1#12.6 ; FPC1#4.5 FPC1#4.6 ; FPC3#35.5 FPC3#35.6 79.41,10.32 v1(79.53,10.44) ; FPC1#5.5 FPC1#5.6 ; FPC1#36.5 FPC1#36.6 ; FPC3#18.5 FPC3#18.6 52.11,24.04 v1(52.23,24.16) ; FPC1#17.5 FPC1#17.6 ; FPC1#31.5 FPC1#31.6 ; FPC1#18.5 FPC1#18.6 ; FPC1#8.5 FPC1#8.6
  Bottom Layer w0.127: 23.55,38.13 23.55,36.86 C10#4.2 ; C4#33.2 35.59,52.1 35.81,52.31 36.48,52.31 36.76,52.04 C9#33.1 ; C4#12.2 62.9,79.53 63.11,79.75 63.78,79.75 64.06,79.47 C9#21.1 ; 78,51.84 77.88,51.97 77.88,52.1 ; C10#6.2 50.85,36.86 50.85,38.13 ; C4#27.2 35.59,65.81 35.81,66.03 36.48,66.03 36.76,65.75 C9#27.1 ; 23.39,10.7 23.27,10.82 23.27,10.95 ; C10#9.2 78.16,78.01 78.16,79.28 ; C4#29.2 62.9,65.81 63.11,66.03 63.78,66.03 64.06,65.75 C9#29.1 ; C10#34.2 50.85,50.58 50.85,51.84 ; C9#20.1 9.45,79.47 9.17,79.75 8.5,79.75 8.29,79.53 C4#21.2 ; 23.27,79.53 23.27,79.4 23.39,79.28 ; 23.27,38.38 23.27,38.25 23.39,38.13 ; 50.58,52.1 50.58,51.97 50.7,51.84 ; C4#35.2 62.9,52.1 63.11,52.31 63.78,52.31 64.06,52.04 C9#35.1 ; C4#14.2 62.9,24.67 63.11,24.88 63.78,24.88 64.06,24.61 C9.1 ; 23.55,79.28 23.55,78.01 C10#22.2 ; 50.58,10.95 50.58,10.82 50.7,10.7 ; 78,24.41 77.88,24.53 77.88,24.67 ; 50.7,79.28 50.58,79.4 50.58,79.53 ; C9#16.1 36.76,10.89 36.48,11.17 35.81,11.17 35.59,10.95 C4#17.2 ; 23.39,24.41 23.27,24.53 23.27,24.67 ; 50.58,65.81 50.58,65.68 50.7,65.56 ; C4#9.2 8.29,24.67 8.5,24.88 9.17,24.88 9.45,24.61 C9#10.1 ; C4#23.2 35.59,79.53 35.81,79.75 36.48,79.75 36.76,79.47 C9#23.1 ; 77.88,79.53 77.88,79.4 78,79.28 ; 50.58,38.38 50.58,38.25 50.7,38.13 ; C10#11.2 23.55,23.14 23.55,24.41 ; 78,65.56 77.88,65.68 77.88,65.81 ; C4#15.2 8.29,10.95 8.5,11.17 9.17,11.17 9.45,10.89 C9#14.1 ; 23.39,65.56 23.27,65.68 23.27,65.81 ; C9#31.1 9.45,52.04 9.17,52.31 8.5,52.31 8.29,52.1 C4#31.2 ; C10#17.2 50.85,9.43 50.85,10.7 ; 78,38.13 77.88,38.25 77.88,38.38 ; C10#32.2 23.55,50.58 23.55,51.84 ; C10#19.2 78.16,9.43 78.16,10.7 ; C4#19.2 62.9,10.95 63.11,11.17 63.78,11.17 64.06,10.89 C9#18.1 ; C9#7.1 64.06,38.32 63.78,38.6 63.11,38.6 62.9,38.38 C4#6.2 ; C9#12.1 36.76,24.61 36.48,24.88 35.81,24.88 35.59,24.67 C4#11.2 ; C10#36.2 78.16,50.58 78.16,51.84 ; 50.85,24.41 50.85,23.14 C10#13.2 ; 50.58,24.67 50.58,24.53 50.7,24.41 ; 78,10.7 77.88,10.82 77.88,10.95 ; 23.55,65.56 23.55,64.29 C10#26.2 ; C4#25.2 8.29,65.81 8.5,66.03 9.17,66.03 9.45,65.75 C9#25.1 ; C10#15.2 23.55,9.43 23.55,10.7 ; C10#30.2 78.16,64.29 78.16,65.56 ; 78.16,38.13 78.16,36.86 C10#8.2 ; 23.39,51.84 23.27,51.97 23.27,52.1 ; C9#3.1 9.45,38.32 9.17,38.6 8.5,38.6 8.29,38.38 C4#2.2 ; C10#24.2 50.85,78.01 50.85,79.28 ; C10#2.2 78.16,23.14 78.16,24.41 ; C10#28.2 50.85,64.29 50.85,65.56 ; C4#4.2 35.59,38.38 35.81,38.6 36.48,38.6 36.76,38.32 C9#5.1
  Bottom Layer w0.15: v1(23.67,65.28) 23.67,65.42 23.15,65.94 22.15,65.94 C4#26.2 ; C4#8.2 76.76,79.66 77.75,79.66 78.28,79.13 v1(78.28,79) ; v1(78.28,51.57) 78.28,51.7 77.75,52.23 76.76,52.23 C4#36.2 ; C4#13.2 49.46,24.79 50.45,24.79 50.98,24.27 v1(50.98,24.13) ; v1(78.28,65.28) 78.28,65.42 77.75,65.94 76.76,65.94 C4#30.2 ; v1(50.98,10.42) 50.98,10.55 50.45,11.08 49.46,11.08 C4#18.2 ; v1(50.98,51.57) 50.98,51.7 50.45,52.23 49.46,52.23 C4#34.2 ; C4.2 76.76,24.79 77.75,24.79 78.28,24.27 v1(78.28,24.13) ; C4#28.2 49.46,65.94 50.45,65.94 50.98,65.42 v1(50.98,65.28) ; C4#5.2 49.46,38.51 50.45,38.51 50.98,37.98 v1(50.98,37.85) ; C4#3.2 22.15,38.51 23.15,38.51 23.67,37.98 v1(23.67,37.85) ; C4#20.2 76.76,11.08 77.75,11.08 78.28,10.55 v1(78.28,10.42) ; v1(23.67,10.42) 23.67,10.55 23.15,11.08 22.15,11.08 C4#16.2 ; C4#32.2 22.15,52.23 23.15,52.23 23.67,51.7 v1(23.67,51.57) ; C4#10.2 22.15,24.79 23.15,24.79 23.67,24.27 v1(23.67,24.13) ; v1(50.98,79) 50.98,79.13 50.45,79.66 49.46,79.66 C4#24.2 ; C4#7.2 76.76,38.51 77.75,38.51 78.28,37.98 v1(78.28,37.85) ; C4#22.2 22.15,79.66 23.15,79.66 23.67,79.13 v1(23.67,79)
  Bottom Layer w0.152: U2#26.18 58.21,48.82 58.36,48.67 58.45,48.67 58.48,48.64 58.6,48.64 59.21,48.03 U3#89.5 ; U2#21.18 30.91,48.82 31.06,48.67 31.15,48.67 31.17,48.64 31.29,48.64 31.9,48.03 U3#75.5 ; U2#13.18 58.21,62.53 58.36,62.39 58.45,62.39 58.48,62.36 58.6,62.36 59.21,61.75 U3#63.5 ; U3#93.5 59.21,20.6 58.6,21.21 58.48,21.21 58.45,21.24 58.36,21.24 58.21,21.39 U2#17.18 ; U2#23.18 58.21,7.67 58.36,7.52 58.45,7.52 58.48,7.5 58.6,7.5 59.21,6.89 U3#85.5 ; U3#82.5 59.21,34.32 58.6,34.93 58.48,34.93 58.45,34.95 58.36,34.95 58.21,35.1 U2#10.18 ; U2#8.18 30.91,35.1 31.06,34.95 31.15,34.95 31.17,34.93 31.29,34.93 31.9,34.32 U3#70.5 ; U2#31.18 30.91,62.53 31.06,62.39 31.15,62.39 31.17,62.36 31.29,62.36 31.9,61.75 U3#76.5 ; U3#74.5 4.6,61.75 3.99,62.36 3.87,62.36 3.84,62.39 3.75,62.39 3.6,62.53 U2#29.18 ; U2#15.18 58.21,76.25 58.36,76.1 58.45,76.1 58.48,76.08 58.6,76.08 59.21,75.47 U3#66.5 ; U2#30.18 3.6,48.82 3.75,48.67 3.84,48.67 3.87,48.64 3.99,48.64 4.6,48.03 U3#68.5 ; U2#4.18 3.6,35.1 3.75,34.95 3.84,34.95 3.87,34.93 3.99,34.93 4.6,34.32 U3#65.5 ; U2#27.18 30.91,76.25 31.06,76.1 31.15,76.1 31.17,76.08 31.29,76.08 31.9,75.47 U3#77.5 ; U2#25.18 30.91,7.67 31.06,7.52 31.15,7.52 31.17,7.5 31.29,7.5 31.9,6.89 U3#92.5 ; U2#9.18 30.91,21.39 31.06,21.24 31.15,21.24 31.17,21.21 31.29,21.21 31.9,20.6 U3#73.5 ; U3#96.5 4.6,75.47 3.99,76.08 3.87,76.08 3.84,76.1 3.75,76.1 3.6,76.25 U2.18 ; U3#91.5 4.6,6.89 3.99,7.5 3.87,7.5 3.84,7.52 3.75,7.52 3.6,7.67 U2#11.18 ; U3#72.5 4.6,20.6 3.99,21.21 3.87,21.21 3.84,21.24 3.75,21.24 3.6,21.39 U2#33.18